# EAGLE board Resistor_Resistor (EAGLE 8.3.0), part 15 of 32
## Placement (x,y rotation side) (continued)
R17993  10K  [0201]  133.86,118.31 0 top
R17994  10K  [0201]  133.86,118.92 0 top
R17995  10K  [0201]  133.86,119.53 0 top
R17996  10K  [0201]  133.86,120.14 0 top
R17997  10K  [0201]  133.86,120.75 0 top
R17998  10K  [0201]  133.86,121.36 0 top
R17999  10K  [0201]  133.86,121.97 0 top
R18000  10K  [0201]  133.86,122.58 0 top
R18001  10K  [0201]  135.08,1.27 0 top
R18002  10K  [0201]  135.08,1.88 0 top
R18003  10K  [0201]  135.08,2.49 0 top
R18004  10K  [0201]  135.08,3.1 0 top
R18005  10K  [0201]  135.08,3.71 0 top
R18006  10K  [0201]  135.08,4.32 0 top
R18007  10K  [0201]  135.08,4.93 0 top
R18008  10K  [0201]  135.08,5.54 0 top
R18009  10K  [0201]  135.08,6.15 0 top
R18010  10K  [0201]  135.08,6.76 0 top
R18011  10K  [0201]  135.08,7.37 0 top
R18012  10K  [0201]  135.08,7.98 0 top
R18013  10K  [0201]  135.08,8.59 0 top
R18014  10K  [0201]  135.08,9.19 0 top
R18015  10K  [0201]  135.08,9.8 0 top
R18016  10K  [0201]  135.08,10.41 0 top
R18017  10K  [0201]  135.08,11.02 0 top
R18018  10K  [0201]  135.08,11.63 0 top
R18019  10K  [0201]  135.08,12.24 0 top
R18020  10K  [0201]  135.08,12.85 0 top
R18021  10K  [0201]  135.08,13.46 0 top
R18022  10K  [0201]  135.08,14.07 0 top
R18023  10K  [0201]  135.08,14.68 0 top
R18024  10K  [0201]  135.08,15.29 0 top
R18025  10K  [0201]  135.08,15.9 0 top
R18026  10K  [0201]  135.08,16.51 0 top
R18027  10K  [0201]  135.08,17.12 0 top
R18028  10K  [0201]  135.08,17.73 0 top
R18029  10K  [0201]  135.08,18.34 0 top
R18030  10K  [0201]  135.08,18.95 0 top
R18031  10K  [0201]  135.08,19.56 0 top
R18032  10K  [0201]  135.08,20.17 0 top
R18033  10K  [0201]  135.08,20.78 0 top
R18034  10K  [0201]  135.08,21.39 0 top
R18035  10K  [0201]  135.08,22 0 top
R18036  10K  [0201]  135.08,22.61 0 top
R18037  10K  [0201]  135.08,23.22 0 top
R18038  10K  [0201]  135.08,23.83 0 top
R18039  10K  [0201]  135.08,24.43 0 top
R18040  10K  [0201]  135.08,25.04 0 top
R18041  10K  [0201]  135.08,25.65 0 top
R18042  10K  [0201]  135.08,26.26 0 top
R18043  10K  [0201]  135.08,26.87 0 top
R18044  10K  [0201]  135.08,27.48 0 top
R18045  10K  [0201]  135.08,28.09 0 top
R18046  10K  [0201]  135.08,28.7 0 top
R18047  10K  [0201]  135.08,29.31 0 top
R18048  10K  [0201]  135.08,29.92 0 top
R18049  10K  [0201]  135.08,30.53 0 top
R18050  10K  [0201]  135.08,31.14 0 top
R18051  10K  [0201]  135.08,31.75 0 top
R18052  10K  [0201]  135.08,32.36 0 top
R18053  10K  [0201]  135.08,32.97 0 top
R18054  10K  [0201]  135.08,33.58 0 top
R18055  10K  [0201]  135.08,34.19 0 top
R18056  10K  [0201]  135.08,34.8 0 top
R18057  10K  [0201]  135.08,35.41 0 top
R18058  10K  [0201]  135.08,36.02 0 top
R18059  10K  [0201]  135.08,36.63 0 top
R18060  10K  [0201]  135.08,37.24 0 top
R18061  10K  [0201]  135.08,37.85 0 top
R18062  10K  [0201]  135.08,38.46 0 top
R18063  10K  [0201]  135.08,39.07 0 top
R18064  10K  [0201]  135.08,39.67 0 top
R18065  10K  [0201]  135.08,40.28 0 top
R18066  10K  [0201]  135.08,40.89 0 top
R18067  10K  [0201]  135.08,41.5 0 top
R18068  10K  [0201]  135.08,42.11 0 top
R18069  10K  [0201]  135.08,42.72 0 top
R18070  10K  [0201]  135.08,43.33 0 top
R18071  10K  [0201]  135.08,43.94 0 top
R18072  10K  [0201]  135.08,44.55 0 top
R18073  10K  [0201]  135.08,45.16 0 top
R18074  10K  [0201]  135.08,45.77 0 top
R18075  10K  [0201]  135.08,46.38 0 top
R18076  10K  [0201]  135.08,46.99 0 top
R18077  10K  [0201]  135.08,47.6 0 top
R18078  10K  [0201]  135.08,48.21 0 top
R18079  10K  [0201]  135.08,48.82 0 top
R18080  10K  [0201]  135.08,49.43 0 top
R18081  10K  [0201]  135.08,50.04 0 top
R18082  10K  [0201]  135.08,50.65 0 top
R18083  10K  [0201]  135.08,51.26 0 top
R18084  10K  [0201]  135.08,51.87 0 top
R18085  10K  [0201]  135.08,52.48 0 top
R18086  10K  [0201]  135.08,53.09 0 top
R18087  10K  [0201]  135.08,53.7 0 top
R18088  10K  [0201]  135.08,54.31 0 top
R18089  10K  [0201]  135.08,54.91 0 top
R18090  10K  [0201]  135.08,55.52 0 top
R18091  10K  [0201]  135.08,56.13 0 top
R18092  10K  [0201]  135.08,56.74 0 top
R18093  10K  [0201]  135.08,57.35 0 top
R18094  10K  [0201]  135.08,57.96 0 top
R18095  10K  [0201]  135.08,58.57 0 top
R18096  10K  [0201]  135.08,59.18 0 top
R18097  10K  [0201]  135.08,59.79 0 top
R18098  10K  [0201]  135.08,60.4 0 top
R18099  10K  [0201]  135.08,61.01 0 top
R18100  10K  [0201]  135.08,61.62 0 top
R18101  10K  [0201]  135.08,62.23 0 top
R18102  10K  [0201]  135.08,62.84 0 top
R18103  10K  [0201]  135.08,63.45 0 top
R18104  10K  [0201]  135.08,64.06 0 top
R18105  10K  [0201]  135.08,64.67 0 top
R18106  10K  [0201]  135.08,65.28 0 top
R18107  10K  [0201]  135.08,65.89 0 top
R18108  10K  [0201]  135.08,66.5 0 top
R18109  10K  [0201]  135.08,67.11 0 top
R18110  10K  [0201]  135.08,67.72 0 top
R18111  10K  [0201]  135.08,68.33 0 top
R18112  10K  [0201]  135.08,68.94 0 top
R18113  10K  [0201]  135.08,69.55 0 top
R18114  10K  [0201]  135.08,70.15 0 top
R18115  10K  [0201]  135.08,70.76 0 top
R18116  10K  [0201]  135.08,71.37 0 top
R18117  10K  [0201]  135.08,71.98 0 top
R18118  10K  [0201]  135.08,72.59 0 top
R18119  10K  [0201]  135.08,73.2 0 top
R18120  10K  [0201]  135.08,73.81 0 top
R18121  10K  [0201]  135.08,74.42 0 top
R18122  10K  [0201]  135.08,75.03 0 top
R18123  10K  [0201]  135.08,75.64 0 top
R18124  10K  [0201]  135.08,76.25 0 top
R18125  10K  [0201]  135.08,76.86 0 top
R18126  10K  [0201]  135.08,77.47 0 top
R18127  10K  [0201]  135.08,78.08 0 top
R18128  10K  [0201]  135.08,78.69 0 top
R18129  10K  [0201]  135.08,79.3 0 top
R18130  10K  [0201]  135.08,79.91 0 top
R18131  10K  [0201]  135.08,80.52 0 top
R18132  10K  [0201]  135.08,81.13 0 top
R18133  10K  [0201]  135.08,81.74 0 top
R18134  10K  [0201]  135.08,82.35 0 top
R18135  10K  [0201]  135.08,82.96 0 top
R18136  10K  [0201]  135.08,83.57 0 top
R18137  10K  [0201]  135.08,84.18 0 top
R18138  10K  [0201]  135.08,84.79 0 top
R18139  10K  [0201]  135.08,85.39 0 top
R18140  10K  [0201]  135.08,86 0 top
R18141  10K  [0201]  135.08,86.61 0 top
R18142  10K  [0201]  135.08,87.22 0 top
R18143  10K  [0201]  135.08,87.83 0 top
R18144  10K  [0201]  135.08,88.44 0 top
R18145  10K  [0201]  135.08,89.05 0 top
R18146  10K  [0201]  135.08,89.66 0 top
R18147  10K  [0201]  135.08,90.27 0 top
R18148  10K  [0201]  135.08,90.88 0 top
R18149  10K  [0201]  135.08,91.49 0 top
R18150  10K  [0201]  135.08,92.1 0 top
R18151  10K  [0201]  135.08,92.71 0 top
R18152  10K  [0201]  135.08,93.32 0 top
R18153  10K  [0201]  135.08,93.93 0 top
R18154  10K  [0201]  135.08,94.54 0 top
R18155  10K  [0201]  135.08,95.15 0 top
R18156  10K  [0201]  135.08,95.76 0 top
R18157  10K  [0201]  135.08,96.37 0 top
R18158  10K  [0201]  135.08,96.98 0 top
R18159  10K  [0201]  135.08,97.59 0 top
R18160  10K  [0201]  135.08,98.2 0 top
R18161  10K  [0201]  135.08,98.81 0 top
R18162  10K  [0201]  135.08,99.42 0 top
R18163  10K  [0201]  135.08,100.03 0 top
R18164  10K  [0201]  135.08,100.63 0 top
R18165  10K  [0201]  135.08,101.24 0 top
R18166  10K  [0201]  135.08,101.85 0 top
R18167  10K  [0201]  135.08,102.46 0 top
R18168  10K  [0201]  135.08,103.07 0 top
R18169  10K  [0201]  135.08,103.68 0 top
R18170  10K  [0201]  135.08,104.29 0 top
R18171  10K  [0201]  135.08,104.9 0 top
R18172  10K  [0201]  135.08,105.51 0 top
R18173  10K  [0201]  135.08,106.12 0 top
R18174  10K  [0201]  135.08,106.73 0 top
R18175  10K  [0201]  135.08,107.34 0 top
R18176  10K  [0201]  135.08,107.95 0 top
R18177  10K  [0201]  135.08,108.56 0 top
R18178  10K  [0201]  135.08,109.17 0 top
R18179  10K  [0201]  135.08,109.78 0 top
R18180  10K  [0201]  135.08,110.39 0 top
R18181  10K  [0201]  135.08,111 0 top
R18182  10K  [0201]  135.08,111.61 0 top
R18183  10K  [0201]  135.08,112.22 0 top
R18184  10K  [0201]  135.08,112.83 0 top
R18185  10K  [0201]  135.08,113.44 0 top
R18186  10K  [0201]  135.08,114.05 0 top
R18187  10K  [0201]  135.08,114.66 0 top
R18188  10K  [0201]  135.08,115.27 0 top
R18189  10K  [0201]  135.08,115.87 0 top
R18190  10K  [0201]  135.08,116.48 0 top
R18191  10K  [0201]  135.08,117.09 0 top
R18192  10K  [0201]  135.08,117.7 0 top
R18193  10K  [0201]  135.08,118.31 0 top
R18194  10K  [0201]  135.08,118.92 0 top
R18195  10K  [0201]  135.08,119.53 0 top
R18196  10K  [0201]  135.08,120.14 0 top
R18197  10K  [0201]  135.08,120.75 0 top
R18198  10K  [0201]  135.08,121.36 0 top
R18199  10K  [0201]  135.08,121.97 0 top
R18200  10K  [0201]  135.08,122.58 0 top
R18201  10K  [0201]  136.3,1.27 0 top
R18202  10K  [0201]  136.3,1.88 0 top
R18203  10K  [0201]  136.3,2.49 0 top
R18204  10K  [0201]  136.3,3.1 0 top
R18205  10K  [0201]  136.3,3.71 0 top
R18206  10K  [0201]  136.3,4.32 0 top
R18207  10K  [0201]  136.3,4.93 0 top
R18208  10K  [0201]  136.3,5.54 0 top
R18209  10K  [0201]  136.3,6.15 0 top
R18210  10K  [0201]  136.3,6.76 0 top
R18211  10K  [0201]  136.3,7.37 0 top
R18212  10K  [0201]  136.3,7.98 0 top
R18213  10K  [0201]  136.3,8.59 0 top
R18214  10K  [0201]  136.3,9.19 0 top
R18215  10K  [0201]  136.3,9.8 0 top
R18216  10K  [0201]  136.3,10.41 0 top
R18217  10K  [0201]  136.3,11.02 0 top
R18218  10K  [0201]  136.3,11.63 0 top
R18219  10K  [0201]  136.3,12.24 0 top
R18220  10K  [0201]  136.3,12.85 0 top
R18221  10K  [0201]  136.3,13.46 0 top
R18222  10K  [0201]  136.3,14.07 0 top
R18223  10K  [0201]  136.3,14.68 0 top
R18224  10K  [0201]  136.3,15.29 0 top
R18225  10K  [0201]  136.3,15.9 0 top
R18226  10K  [0201]  136.3,16.51 0 top
R18227  10K  [0201]  136.3,17.12 0 top
R18228  10K  [0201]  136.3,17.73 0 top
R18229  10K  [0201]  136.3,18.34 0 top
R18230  10K  [0201]  136.3,18.95 0 top
R18231  10K  [0201]  136.3,19.56 0 top
R18232  10K  [0201]  136.3,20.17 0 top
R18233  10K  [0201]  136.3,20.78 0 top
R18234  10K  [0201]  136.3,21.39 0 top
R18235  10K  [0201]  136.3,22 0 top
R18236  10K  [0201]  136.3,22.61 0 top
R18237  10K  [0201]  136.3,23.22 0 top
R18238  10K  [0201]  136.3,23.83 0 top
R18239  10K  [0201]  136.3,24.43 0 top
R18240  10K  [0201]  136.3,25.04 0 top
R18241  10K  [0201]  136.3,25.65 0 top
R18242  10K  [0201]  136.3,26.26 0 top
R18243  10K  [0201]  136.3,26.87 0 top
R18244  10K  [0201]  136.3,27.48 0 top
R18245  10K  [0201]  136.3,28.09 0 top
R18246  10K  [0201]  136.3,28.7 0 top
R18247  10K  [0201]  136.3,29.31 0 top
R18248  10K  [0201]  136.3,29.92 0 top
R18249  10K  [0201]  136.3,30.53 0 top
R18250  10K  [0201]  136.3,31.14 0 top
R18251  10K  [0201]  136.3,31.75 0 top
R18252  10K  [0201]  136.3,32.36 0 top
R18253  10K  [0201]  136.3,32.97 0 top
R18254  10K  [0201]  136.3,33.58 0 top
R18255  10K  [0201]  136.3,34.19 0 top
R18256  10K  [0201]  136.3,34.8 0 top
R18257  10K  [0201]  136.3,35.41 0 top
R18258  10K  [0201]  136.3,36.02 0 top
R18259  10K  [0201]  136.3,36.63 0 top
R18260  10K  [0201]  136.3,37.24 0 top
R18261  10K  [0201]  136.3,37.85 0 top
R18262  10K  [0201]  136.3,38.46 0 top
R18263  10K  [0201]  136.3,39.07 0 top
R18264  10K  [0201]  136.3,39.67 0 top
R18265  10K  [0201]  136.3,40.28 0 top
R18266  10K  [0201]  136.3,40.89 0 top
R18267  10K  [0201]  136.3,41.5 0 top
R18268  10K  [0201]  136.3,42.11 0 top
R18269  10K  [0201]  136.3,42.72 0 top
R18270  10K  [0201]  136.3,43.33 0 top
R18271  10K  [0201]  136.3,43.94 0 top
R18272  10K  [0201]  136.3,44.55 0 top
R18273  10K  [0201]  136.3,45.16 0 top
R18274  10K  [0201]  136.3,45.77 0 top
R18275  10K  [0201]  136.3,46.38 0 top
R18276  10K  [0201]  136.3,46.99 0 top
R18277  10K  [0201]  136.3,47.6 0 top
R18278  10K  [0201]  136.3,48.21 0 top
R18279  10K  [0201]  136.3,48.82 0 top
R18280  10K  [0201]  136.3,49.43 0 top
R18281  10K  [0201]  136.3,50.04 0 top
R18282  10K  [0201]  136.3,50.65 0 top
R18283  10K  [0201]  136.3,51.26 0 top
R18284  10K  [0201]  136.3,51.87 0 top
R18285  10K  [0201]  136.3,52.48 0 top
R18286  10K  [0201]  136.3,53.09 0 top
R18287  10K  [0201]  136.3,53.7 0 top
R18288  10K  [0201]  136.3,54.31 0 top
R18289  10K  [0201]  136.3,54.91 0 top
R18290  10K  [0201]  136.3,55.52 0 top
R18291  10K  [0201]  136.3,56.13 0 top
R18292  10K  [0201]  136.3,56.74 0 top
R18293  10K  [0201]  136.3,57.35 0 top
R18294  10K  [0201]  136.3,57.96 0 top
R18295  10K  [0201]  136.3,58.57 0 top
R18296  10K  [0201]  136.3,59.18 0 top
R18297  10K  [0201]  136.3,59.79 0 top
R18298  10K  [0201]  136.3,60.4 0 top
R18299  10K  [0201]  136.3,61.01 0 top
R18300  10K  [0201]  136.3,61.62 0 top
R18301  10K  [0201]  136.3,62.23 0 top
R18302  10K  [0201]  136.3,62.84 0 top
R18303  10K  [0201]  136.3,63.45 0 top
R18304  10K  [0201]  136.3,64.06 0 top
R18305  10K  [0201]  136.3,64.67 0 top
R18306  10K  [0201]  136.3,65.28 0 top
R18307  10K  [0201]  136.3,65.89 0 top
R18308  10K  [0201]  136.3,66.5 0 top
R18309  10K  [0201]  136.3,67.11 0 top
R18310  10K  [0201]  136.3,67.72 0 top
R18311  10K  [0201]  136.3,68.33 0 top
R18312  10K  [0201]  136.3,68.94 0 top
R18313  10K  [0201]  136.3,69.55 0 top
R18314  10K  [0201]  136.3,70.15 0 top
R18315  10K  [0201]  136.3,70.76 0 top
R18316  10K  [0201]  136.3,71.37 0 top
R18317  10K  [0201]  136.3,71.98 0 top
R18318  10K  [0201]  136.3,72.59 0 top
R18319  10K  [0201]  136.3,73.2 0 top
R18320  10K  [0201]  136.3,73.81 0 top
R18321  10K  [0201]  136.3,74.42 0 top
R18322  10K  [0201]  136.3,75.03 0 top
R18323  10K  [0201]  136.3,75.64 0 top
R18324  10K  [0201]  136.3,76.25 0 top
R18325  10K  [0201]  136.3,76.86 0 top
R18326  10K  [0201]  136.3,77.47 0 top
R18327  10K  [0201]  136.3,78.08 0 top
R18328  10K  [0201]  136.3,78.69 0 top
R18329  10K  [0201]  136.3,79.3 0 top
R18330  10K  [0201]  136.3,79.91 0 top
R18331  10K  [0201]  136.3,80.52 0 top
R18332  10K  [0201]  136.3,81.13 0 top
R18333  10K  [0201]  136.3,81.74 0 top
R18334  10K  [0201]  136.3,82.35 0 top
R18335  10K  [0201]  136.3,82.96 0 top
R18336  10K  [0201]  136.3,83.57 0 top
R18337  10K  [0201]  136.3,84.18 0 top
R18338  10K  [0201]  136.3,84.79 0 top
R18339  10K  [0201]  136.3,85.39 0 top
R18340  10K  [0201]  136.3,86 0 top
R18341  10K  [0201]  136.3,86.61 0 top
R18342  10K  [0201]  136.3,87.22 0 top
R18343  10K  [0201]  136.3,87.83 0 top
R18344  10K  [0201]  136.3,88.44 0 top
R18345  10K  [0201]  136.3,89.05 0 top
R18346  10K  [0201]  136.3,89.66 0 top
R18347  10K  [0201]  136.3,90.27 0 top
R18348  10K  [0201]  136.3,90.88 0 top
R18349  10K  [0201]  136.3,91.49 0 top
R18350  10K  [0201]  136.3,92.1 0 top
R18351  10K  [0201]  136.3,92.71 0 top
R18352  10K  [0201]  136.3,93.32 0 top
R18353  10K  [0201]  136.3,93.93 0 top
R18354  10K  [0201]  136.3,94.54 0 top
R18355  10K  [0201]  136.3,95.15 0 top
R18356  10K  [0201]  136.3,95.76 0 top
R18357  10K  [0201]  136.3,96.37 0 top
R18358  10K  [0201]  136.3,96.98 0 top
R18359  10K  [0201]  136.3,97.59 0 top
R18360  10K  [0201]  136.3,98.2 0 top
R18361  10K  [0201]  136.3,98.81 0 top
R18362  10K  [0201]  136.3,99.42 0 top
R18363  10K  [0201]  136.3,100.03 0 top
R18364  10K  [0201]  136.3,100.63 0 top
R18365  10K  [0201]  136.3,101.24 0 top
R18366  10K  [0201]  136.3,101.85 0 top
R18367  10K  [0201]  136.3,102.46 0 top
R18368  10K  [0201]  136.3,103.07 0 top
R18369  10K  [0201]  136.3,103.68 0 top
R18370  10K  [0201]  136.3,104.29 0 top
R18371  10K  [0201]  136.3,104.9 0 top
R18372  10K  [0201]  136.3,105.51 0 top
R18373  10K  [0201]  136.3,106.12 0 top
R18374  10K  [0201]  136.3,106.73 0 top
R18375  10K  [0201]  136.3,107.34 0 top
R18376  10K  [0201]  136.3,107.95 0 top
R18377  10K  [0201]  136.3,108.56 0 top
R18378  10K  [0201]  136.3,109.17 0 top
R18379  10K  [0201]  136.3,109.78 0 top
R18380  10K  [0201]  136.3,110.39 0 top
R18381  10K  [0201]  136.3,111 0 top
R18382  10K  [0201]  136.3,111.61 0 top
R18383  10K  [0201]  136.3,112.22 0 top
R18384  10K  [0201]  136.3,112.83 0 top
R18385  10K  [0201]  136.3,113.44 0 top
R18386  10K  [0201]  136.3,114.05 0 top
R18387  10K  [0201]  136.3,114.66 0 top
R18388  10K  [0201]  136.3,115.27 0 top
R18389  10K  [0201]  136.3,115.87 0 top
R18390  10K  [0201]  136.3,116.48 0 top
R18391  10K  [0201]  136.3,117.09 0 top
R18392  10K  [0201]  136.3,117.7 0 top
R18393  10K  [0201]  136.3,118.31 0 top
R18394  10K  [0201]  136.3,118.92 0 top
R18395  10K  [0201]  136.3,119.53 0 top
R18396  10K  [0201]  136.3,120.14 0 top
R18397  10K  [0201]  136.3,120.75 0 top
R18398  10K  [0201]  136.3,121.36 0 top
R18399  10K  [0201]  136.3,121.97 0 top
R18400  10K  [0201]  136.3,122.58 0 top
R18401  10K  [0201]  137.52,1.27 0 top
R18402  10K  [0201]  137.52,1.88 0 top
R18403  10K  [0201]  137.52,2.49 0 top
R18404  10K  [0201]  137.52,3.1 0 top
R18405  10K  [0201]  137.52,3.71 0 top
R18406  10K  [0201]  137.52,4.32 0 top
R18407  10K  [0201]  137.52,4.93 0 top
R18408  10K  [0201]  137.52,5.54 0 top
R18409  10K  [0201]  137.52,6.15 0 top
R18410  10K  [0201]  137.52,6.76 0 top
R18411  10K  [0201]  137.52,7.37 0 top
R18412  10K  [0201]  137.52,7.98 0 top
R18413  10K  [0201]  137.52,8.59 0 top
R18414  10K  [0201]  137.52,9.19 0 top
R18415  10K  [0201]  137.52,9.8 0 top
R18416  10K  [0201]  137.52,10.41 0 top
R18417  10K  [0201]  137.52,11.02 0 top
R18418  10K  [0201]  137.52,11.63 0 top
R18419  10K  [0201]  137.52,12.24 0 top
R18420  10K  [0201]  137.52,12.85 0 top
R18421  10K  [0201]  137.52,13.46 0 top
R18422  10K  [0201]  137.52,14.07 0 top
R18423  10K  [0201]  137.52,14.68 0 top
R18424  10K  [0201]  137.52,15.29 0 top
R18425  10K  [0201]  137.52,15.9 0 top
R18426  10K  [0201]  137.52,16.51 0 top
R18427  10K  [0201]  137.52,17.12 0 top
R18428  10K  [0201]  137.52,17.73 0 top
R18429  10K  [0201]  137.52,18.34 0 top
R18430  10K  [0201]  137.52,18.95 0 top
R18431  10K  [0201]  137.52,19.56 0 top
R18432  10K  [0201]  137.52,20.17 0 top
R18433  10K  [0201]  137.52,20.78 0 top
R18434  10K  [0201]  137.52,21.39 0 top
R18435  10K  [0201]  137.52,22 0 top
R18436  10K  [0201]  137.52,22.61 0 top
R18437  10K  [0201]  137.52,23.22 0 top
R18438  10K  [0201]  137.52,23.83 0 top
R18439  10K  [0201]  137.52,24.43 0 top
R18440  10K  [0201]  137.52,25.04 0 top
R18441  10K  [0201]  137.52,25.65 0 top
R18442  10K  [0201]  137.52,26.26 0 top
R18443  10K  [0201]  137.52,26.87 0 top
R18444  10K  [0201]  137.52,27.48 0 top
R18445  10K  [0201]  137.52,28.09 0 top
R18446  10K  [0201]  137.52,28.7 0 top
R18447  10K  [0201]  137.52,29.31 0 top
R18448  10K  [0201]  137.52,29.92 0 top
R18449  10K  [0201]  137.52,30.53 0 top
R18450  10K  [0201]  137.52,31.14 0 top
R18451  10K  [0201]  137.52,31.75 0 top
R18452  10K  [0201]  137.52,32.36 0 top
R18453  10K  [0201]  137.52,32.97 0 top
R18454  10K  [0201]  137.52,33.58 0 top
R18455  10K  [0201]  137.52,34.19 0 top
R18456  10K  [0201]  137.52,34.8 0 top
R18457  10K  [0201]  137.52,35.41 0 top
R18458  10K  [0201]  137.52,36.02 0 top
R18459  10K  [0201]  137.52,36.63 0 top
R18460  10K  [0201]  137.52,37.24 0 top
R18461  10K  [0201]  137.52,37.85 0 top
R18462  10K  [0201]  137.52,38.46 0 top
R18463  10K  [0201]  137.52,39.07 0 top
R18464  10K  [0201]  137.52,39.67 0 top
R18465  10K  [0201]  137.52,40.28 0 top
R18466  10K  [0201]  137.52,40.89 0 top
R18467  10K  [0201]  137.52,41.5 0 top
R18468  10K  [0201]  137.52,42.11 0 top
R18469  10K  [0201]  137.52,42.72 0 top
R18470  10K  [0201]  137.52,43.33 0 top
R18471  10K  [0201]  137.52,43.94 0 top
R18472  10K  [0201]  137.52,44.55 0 top
R18473  10K  [0201]  137.52,45.16 0 top
R18474  10K  [0201]  137.52,45.77 0 top
R18475  10K  [0201]  137.52,46.38 0 top
R18476  10K  [0201]  137.52,46.99 0 top
R18477  10K  [0201]  137.52,47.6 0 top
R18478  10K  [0201]  137.52,48.21 0 top
R18479  10K  [0201]  137.52,48.82 0 top
R18480  10K  [0201]  137.52,49.43 0 top
R18481  10K  [0201]  137.52,50.04 0 top
R18482  10K  [0201]  137.52,50.65 0 top
R18483  10K  [0201]  137.52,51.26 0 top
R18484  10K  [0201]  137.52,51.87 0 top
R18485  10K  [0201]  137.52,52.48 0 top
R18486  10K  [0201]  137.52,53.09 0 top
R18487  10K  [0201]  137.52,53.7 0 top
R18488  10K  [0201]  137.52,54.31 0 top
R18489  10K  [0201]  137.52,54.91 0 top
R18490  10K  [0201]  137.52,55.52 0 top
R18491  10K  [0201]  137.52,56.13 0 top
R18492  10K  [0201]  137.52,56.74 0 top
R18493  10K  [0201]  137.52,57.35 0 top
R18494  10K  [0201]  137.52,57.96 0 top
R18495  10K  [0201]  137.52,58.57 0 top
R18496  10K  [0201]  137.52,59.18 0 top
R18497  10K  [0201]  137.52,59.79 0 top
R18498  10K  [0201]  137.52,60.4 0 top
R18499  10K  [0201]  137.52,61.01 0 top
R18500  10K  [0201]  137.52,61.62 0 top
R18501  10K  [0201]  137.52,62.23 0 top
R18502  10K  [0201]  137.52,62.84 0 top
R18503  10K  [0201]  137.52,63.45 0 top
R18504  10K  [0201]  137.52,64.06 0 top
R18505  10K  [0201]  137.52,64.67 0 top
R18506  10K  [0201]  137.52,65.28 0 top
R18507  10K  [0201]  137.52,65.89 0 top
R18508  10K  [0201]  137.52,66.5 0 top
R18509  10K  [0201]  137.52,67.11 0 top
R18510  10K  [0201]  137.52,67.72 0 top
R18511  10K  [0201]  137.52,68.33 0 top
R18512  10K  [0201]  137.52,68.94 0 top
R18513  10K  [0201]  137.52,69.55 0 top
R18514  10K  [0201]  137.52,70.15 0 top
R18515  10K  [0201]  137.52,70.76 0 top
R18516  10K  [0201]  137.52,71.37 0 top
R18517  10K  [0201]  137.52,71.98 0 top
R18518  10K  [0201]  137.52,72.59 0 top
R18519  10K  [0201]  137.52,73.2 0 top
R18520  10K  [0201]  137.52,73.81 0 top
R18521  10K  [0201]  137.52,74.42 0 top
R18522  10K  [0201]  137.52,75.03 0 top
R18523  10K  [0201]  137.52,75.64 0 top
R18524  10K  [0201]  137.52,76.25 0 top
R18525  10K  [0201]  137.52,76.86 0 top
R18526  10K  [0201]  137.52,77.47 0 top
R18527  10K  [0201]  137.52,78.08 0 top
R18528  10K  [0201]  137.52,78.69 0 top
R18529  10K  [0201]  137.52,79.3 0 top
R18530  10K  [0201]  137.52,79.91 0 top
R18531  10K  [0201]  137.52,80.52 0 top
R18532  10K  [0201]  137.52,81.13 0 top
R18533  10K  [0201]  137.52,81.74 0 top
R18534  10K  [0201]  137.52,82.35 0 top
R18535  10K  [0201]  137.52,82.96 0 top
R18536  10K  [0201]  137.52,83.57 0 top
R18537  10K  [0201]  137.52,84.18 0 top
R18538  10K  [0201]  137.52,84.79 0 top
R18539  10K  [0201]  137.52,85.39 0 top
R18540  10K  [0201]  137.52,86 0 top
R18541  10K  [0201]  137.52,86.61 0 top
R18542  10K  [0201]  137.52,87.22 0 top
R18543  10K  [0201]  137.52,87.83 0 top
R18544  10K  [0201]  137.52,88.44 0 top
R18545  10K  [0201]  137.52,89.05 0 top
R18546  10K  [0201]  137.52,89.66 0 top
R18547  10K  [0201]  137.52,90.27 0 top
R18548  10K  [0201]  137.52,90.88 0 top
R18549  10K  [0201]  137.52,91.49 0 top
R18550  10K  [0201]  137.52,92.1 0 top
R18551  10K  [0201]  137.52,92.71 0 top
R18552  10K  [0201]  137.52,93.32 0 top
R18553  10K  [0201]  137.52,93.93 0 top
R18554  10K  [0201]  137.52,94.54 0 top
R18555  10K  [0201]  137.52,95.15 0 top
R18556  10K  [0201]  137.52,95.76 0 top
R18557  10K  [0201]  137.52,96.37 0 top
R18558  10K  [0201]  137.52,96.98 0 top
R18559  10K  [0201]  137.52,97.59 0 top
R18560  10K  [0201]  137.52,98.2 0 top
R18561  10K  [0201]  137.52,98.81 0 top
R18562  10K  [0201]  137.52,99.42 0 top
R18563  10K  [0201]  137.52,100.03 0 top
R18564  10K  [0201]  137.52,100.63 0 top
R18565  10K  [0201]  137.52,101.24 0 top
R18566  10K  [0201]  137.52,101.85 0 top
R18567  10K  [0201]  137.52,102.46 0 top
R18568  10K  [0201]  137.52,103.07 0 top
R18569  10K  [0201]  137.52,103.68 0 top
R18570  10K  [0201]  137.52,104.29 0 top
R18571  10K  [0201]  137.52,104.9 0 top
R18572  10K  [0201]  137.52,105.51 0 top
R18573  10K  [0201]  137.52,106.12 0 top
R18574  10K  [0201]  137.52,106.73 0 top
R18575  10K  [0201]  137.52,107.34 0 top
R18576  10K  [0201]  137.52,107.95 0 top
R18577  10K  [0201]  137.52,108.56 0 top
R18578  10K  [0201]  137.52,109.17 0 top
R18579  10K  [0201]  137.52,109.78 0 top
R18580  10K  [0201]  137.52,110.39 0 top
R18581  10K  [0201]  137.52,111 0 top
R18582  10K  [0201]  137.52,111.61 0 top
R18583  10K  [0201]  137.52,112.22 0 top
R18584  10K  [0201]  137.52,112.83 0 top
R18585  10K  [0201]  137.52,113.44 0 top
R18586  10K  [0201]  137.52,114.05 0 top
R18587  10K  [0201]  137.52,114.66 0 top
R18588  10K  [0201]  137.52,115.27 0 top
R18589  10K  [0201]  137.52,115.87 0 top
R18590  10K  [0201]  137.52,116.48 0 top
R18591  10K  [0201]  137.52,117.09 0 top
R18592  10K  [0201]  137.52,117.7 0 top
R18593  10K  [0201]  137.52,118.31 0 top
R18594  10K  [0201]  137.52,118.92 0 top
R18595  10K  [0201]  137.52,119.53 0 top
R18596  10K  [0201]  137.52,120.14 0 top
R18597  10K  [0201]  137.52,120.75 0 top
R18598  10K  [0201]  137.52,121.36 0 top
R18599  10K  [0201]  137.52,121.97 0 top
R18600  10K  [0201]  137.52,122.58 0 top
R18601  10K  [0201]  138.73,1.27 0 top
R18602  10K  [0201]  138.73,1.88 0 top
R18603  10K  [0201]  138.73,2.49 0 top
R18604  10K  [0201]  138.73,3.1 0 top
R18605  10K  [0201]  138.73,3.71 0 top
R18606  10K  [0201]  138.73,4.32 0 top
R18607  10K  [0201]  138.73,4.93 0 top
R18608  10K  [0201]  138.73,5.54 0 top
R18609  10K  [0201]  138.73,6.15 0 top
R18610  10K  [0201]  138.73,6.76 0 top
R18611  10K  [0201]  138.73,7.37 0 top
R18612  10K  [0201]  138.73,7.98 0 top
R18613  10K  [0201]  138.73,8.59 0 top
R18614  10K  [0201]  138.73,9.19 0 top
R18615  10K  [0201]  138.73,9.8 0 top
R18616  10K  [0201]  138.73,10.41 0 top
R18617  10K  [0201]  138.73,11.02 0 top
R18618  10K  [0201]  138.73,11.63 0 top
R18619  10K  [0201]  138.73,12.24 0 top
R18620  10K  [0201]  138.73,12.85 0 top
R18621  10K  [0201]  138.73,13.46 0 top
R18622  10K  [0201]  138.73,14.07 0 top
R18623  10K  [0201]  138.73,14.68 0 top
R18624  10K  [0201]  138.73,15.29 0 top
R18625  10K  [0201]  138.73,15.9 0 top
R18626  10K  [0201]  138.73,16.51 0 top
R18627  10K  [0201]  138.73,17.12 0 top
R18628  10K  [0201]  138.73,17.73 0 top
R18629  10K  [0201]  138.73,18.34 0 top
R18630  10K  [0201]  138.73,18.95 0 top
R18631  10K  [0201]  138.73,19.56 0 top
R18632  10K  [0201]  138.73,20.17 0 top
R18633  10K  [0201]  138.73,20.78 0 top
R18634  10K  [0201]  138.73,21.39 0 top
R18635  10K  [0201]  138.73,22 0 top
R18636  10K  [0201]  138.73,22.61 0 top
R18637  10K  [0201]  138.73,23.22 0 top
R18638  10K  [0201]  138.73,23.83 0 top
R18639  10K  [0201]  138.73,24.43 0 top
R18640  10K  [0201]  138.73,25.04 0 top
R18641  10K  [0201]  138.73,25.65 0 top
R18642  10K  [0201]  138.73,26.26 0 top
R18643  10K  [0201]  138.73,26.87 0 top
R18644  10K  [0201]  138.73,27.48 0 top
R18645  10K  [0201]  138.73,28.09 0 top
R18646  10K  [0201]  138.73,28.7 0 top
R18647  10K  [0201]  138.73,29.31 0 top
R18648  10K  [0201]  138.73,29.92 0 top
R18649  10K  [0201]  138.73,30.53 0 top
R18650  10K  [0201]  138.73,31.14 0 top
R18651  10K  [0201]  138.73,31.75 0 top
R18652  10K  [0201]  138.73,32.36 0 top
R18653  10K  [0201]  138.73,32.97 0 top
R18654  10K  [0201]  138.73,33.58 0 top
R18655  10K  [0201]  138.73,34.19 0 top
R18656  10K  [0201]  138.73,34.8 0 top
R18657  10K  [0201]  138.73,35.41 0 top
R18658  10K  [0201]  138.73,36.02 0 top
R18659  10K  [0201]  138.73,36.63 0 top
R18660  10K  [0201]  138.73,37.24 0 top
R18661  10K  [0201]  138.73,37.85 0 top
R18662  10K  [0201]  138.73,38.46 0 top
R18663  10K  [0201]  138.73,39.07 0 top
R18664  10K  [0201]  138.73,39.67 0 top
R18665  10K  [0201]  138.73,40.28 0 top
R18666  10K  [0201]  138.73,40.89 0 top
R18667  10K  [0201]  138.73,41.5 0 top
R18668  10K  [0201]  138.73,42.11 0 top
R18669  10K  [0201]  138.73,42.72 0 top
R18670  10K  [0201]  138.73,43.33 0 top
R18671  10K  [0201]  138.73,43.94 0 top
R18672  10K  [0201]  138.73,44.55 0 top
R18673  10K  [0201]  138.73,45.16 0 top
R18674  10K  [0201]  138.73,45.77 0 top
R18675  10K  [0201]  138.73,46.38 0 top
R18676  10K  [0201]  138.73,46.99 0 top
R18677  10K  [0201]  138.73,47.6 0 top
R18678  10K  [0201]  138.73,48.21 0 top
R18679  10K  [0201]  138.73,48.82 0 top
R18680  10K  [0201]  138.73,49.43 0 top
R18681  10K  [0201]  138.73,50.04 0 top
R18682  10K  [0201]  138.73,50.65 0 top
R18683  10K  [0201]  138.73,51.26 0 top
R18684  10K  [0201]  138.73,51.87 0 top
R18685  10K  [0201]  138.73,52.48 0 top
R18686  10K  [0201]  138.73,53.09 0 top
R18687  10K  [0201]  138.73,53.7 0 top
R18688  10K  [0201]  138.73,54.31 0 top
R18689  10K  [0201]  138.73,54.91 0 top
R18690  10K  [0201]  138.73,55.52 0 top
R18691  10K  [0201]  138.73,56.13 0 top
R18692  10K  [0201]  138.73,56.74 0 top
R18693  10K  [0201]  138.73,57.35 0 top
R18694  10K  [0201]  138.73,57.96 0 top
R18695  10K  [0201]  138.73,58.57 0 top
R18696  10K  [0201]  138.73,59.18 0 top
R18697  10K  [0201]  138.73,59.79 0 top
R18698  10K  [0201]  138.73,60.4 0 top
R18699  10K  [0201]  138.73,61.01 0 top
R18700  10K  [0201]  138.73,61.62 0 top
R18701  10K  [0201]  138.73,62.23 0 top
R18702  10K  [0201]  138.73,62.84 0 top
R18703  10K  [0201]  138.73,63.45 0 top
R18704  10K  [0201]  138.73,64.06 0 top
R18705  10K  [0201]  138.73,64.67 0 top
R18706  10K  [0201]  138.73,65.28 0 top
R18707  10K  [0201]  138.73,65.89 0 top
R18708  10K  [0201]  138.73,66.5 0 top
R18709  10K  [0201]  138.73,67.11 0 top
R18710  10K  [0201]  138.73,67.72 0 top
R18711  10K  [0201]  138.73,68.33 0 top
R18712  10K  [0201]  138.73,68.94 0 top
R18713  10K  [0201]  138.73,69.55 0 top
R18714  10K  [0201]  138.73,70.15 0 top
R18715  10K  [0201]  138.73,70.76 0 top
R18716  10K  [0201]  138.73,71.37 0 top
R18717  10K  [0201]  138.73,71.98 0 top
R18718  10K  [0201]  138.73,72.59 0 top
R18719  10K  [0201]  138.73,73.2 0 top
R18720  10K  [0201]  138.73,73.81 0 top
R18721  10K  [0201]  138.73,74.42 0 top
R18722  10K  [0201]  138.73,75.03 0 top
R18723  10K  [0201]  138.73,75.64 0 top
R18724  10K  [0201]  138.73,76.25 0 top
R18725  10K  [0201]  138.73,76.86 0 top
R18726  10K  [0201]  138.73,77.47 0 top
R18727  10K  [0201]  138.73,78.08 0 top
R18728  10K  [0201]  138.73,78.69 0 top
R18729  10K  [0201]  138.73,79.3 0 top
R18730  10K  [0201]  138.73,79.91 0 top
R18731  10K  [0201]  138.73,80.52 0 top
R18732  10K  [0201]  138.73,81.13 0 top
R18733  10K  [0201]  138.73,81.74 0 top
R18734  10K  [0201]  138.73,82.35 0 top
R18735  10K  [0201]  138.73,82.96 0 top
R18736  10K  [0201]  138.73,83.57 0 top
R18737  10K  [0201]  138.73,84.18 0 top
R18738  10K  [0201]  138.73,84.79 0 top
R18739  10K  [0201]  138.73,85.39 0 top
R18740  10K  [0201]  138.73,86 0 top
R18741  10K  [0201]  138.73,86.61 0 top
R18742  10K  [0201]  138.73,87.22 0 top
R18743  10K  [0201]  138.73,87.83 0 top
R18744  10K  [0201]  138.73,88.44 0 top
R18745  10K  [0201]  138.73,89.05 0 top
R18746  10K  [0201]  138.73,89.66 0 top
R18747  10K  [0201]  138.73,90.27 0 top
R18748  10K  [0201]  138.73,90.88 0 top
R18749  10K  [0201]  138.73,91.49 0 top
R18750  10K  [0201]  138.73,92.1 0 top
R18751  10K  [0201]  138.73,92.71 0 top
R18752  10K  [0201]  138.73,93.32 0 top
R18753  10K  [0201]  138.73,93.93 0 top
R18754  10K  [0201]  138.73,94.54 0 top
R18755  10K  [0201]  138.73,95.15 0 top
R18756  10K  [0201]  138.73,95.76 0 top
R18757  10K  [0201]  138.73,96.37 0 top
R18758  10K  [0201]  138.73,96.98 0 top
R18759  10K  [0201]  138.73,97.59 0 top
R18760  10K  [0201]  138.73,98.2 0 top
R18761  10K  [0201]  138.73,98.81 0 top
R18762  10K  [0201]  138.73,99.42 0 top
R18763  10K  [0201]  138.73,100.03 0 top
R18764  10K  [0201]  138.73,100.63 0 top
R18765  10K  [0201]  138.73,101.24 0 top
R18766  10K  [0201]  138.73,101.85 0 top
R18767  10K  [0201]  138.73,102.46 0 top
R18768  10K  [0201]  138.73,103.07 0 top
R18769  10K  [0201]  138.73,103.68 0 top
R18770  10K  [0201]  138.73,104.29 0 top
R18771  10K  [0201]  138.73,104.9 0 top
R18772  10K  [0201]  138.73,105.51 0 top
R18773  10K  [0201]  138.73,106.12 0 top
R18774  10K  [0201]  138.73,106.73 0 top
R18775  10K  [0201]  138.73,107.34 0 top
R18776  10K  [0201]  138.73,107.95 0 top
R18777  10K  [0201]  138.73,108.56 0 top
R18778  10K  [0201]  138.73,109.17 0 top
R18779  10K  [0201]  138.73,109.78 0 top
R18780  10K  [0201]  138.73,110.39 0 top
R18781  10K  [0201]  138.73,111 0 top
R18782  10K  [0201]  138.73,111.61 0 top
R18783  10K  [0201]  138.73,112.22 0 top
R18784  10K  [0201]  138.73,112.83 0 top
R18785  10K  [0201]  138.73,113.44 0 top
R18786  10K  [0201]  138.73,114.05 0 top
R18787  10K  [0201]  138.73,114.66 0 top
R18788  10K  [0201]  138.73,115.27 0 top
R18789  10K  [0201]  138.73,115.87 0 top
R18790  10K  [0201]  138.73,116.48 0 top
R18791  10K  [0201]  138.73,117.09 0 top
R18792  10K  [0201]  138.73,117.7 0 top
R18793  10K  [0201]  138.73,118.31 0 top
R18794  10K  [0201]  138.73,118.92 0 top
R18795  10K  [0201]  138.73,119.53 0 top
R18796  10K  [0201]  138.73,120.14 0 top
R18797  10K  [0201]  138.73,120.75 0 top
R18798  10K  [0201]  138.73,121.36 0 top
R18799  10K  [0201]  138.73,121.97 0 top
R18800  10K  [0201]  138.73,122.58 0 top
R18801  10K  [0201]  139.95,1.27 0 top
R18802  10K  [0201]  139.95,1.88 0 top
R18803  10K  [0201]  139.95,2.49 0 top
R18804  10K  [0201]  139.95,3.1 0 top
R18805  10K  [0201]  139.95,3.71 0 top
R18806  10K  [0201]  139.95,4.32 0 top
R18807  10K  [0201]  139.95,4.93 0 top
R18808  10K  [0201]  139.95,5.54 0 top
R18809  10K  [0201]  139.95,6.15 0 top
R18810  10K  [0201]  139.95,6.76 0 top
R18811  10K  [0201]  139.95,7.37 0 top
R18812  10K  [0201]  139.95,7.98 0 top
R18813  10K  [0201]  139.95,8.59 0 top
R18814  10K  [0201]  139.95,9.19 0 top
R18815  10K  [0201]  139.95,9.8 0 top
R18816  10K  [0201]  139.95,10.41 0 top
R18817  10K  [0201]  139.95,11.02 0 top
R18818  10K  [0201]  139.95,11.63 0 top
R18819  10K  [0201]  139.95,12.24 0 top
R18820  10K  [0201]  139.95,12.85 0 top
R18821  10K  [0201]  139.95,13.46 0 top
R18822  10K  [0201]  139.95,14.07 0 top
R18823  10K  [0201]  139.95,14.68 0 top
R18824  10K  [0201]  139.95,15.29 0 top
R18825  10K  [0201]  139.95,15.9 0 top
R18826  10K  [0201]  139.95,16.51 0 top
R18827  10K  [0201]  139.95,17.12 0 top
R18828  10K  [0201]  139.95,17.73 0 top
R18829  10K  [0201]  139.95,18.34 0 top
R18830  10K  [0201]  139.95,18.95 0 top
R18831  10K  [0201]  139.95,19.56 0 top
R18832  10K  [0201]  139.95,20.17 0 top
R18833  10K  [0201]  139.95,20.78 0 top
R18834  10K  [0201]  139.95,21.39 0 top
R18835  10K  [0201]  139.95,22 0 top
R18836  10K  [0201]  139.95,22.61 0 top
R18837  10K  [0201]  139.95,23.22 0 top
R18838  10K  [0201]  139.95,23.83 0 top
R18839  10K  [0201]  139.95,24.43 0 top
R18840  10K  [0201]  139.95,25.04 0 top
R18841  10K  [0201]  139.95,25.65 0 top
R18842  10K  [0201]  139.95,26.26 0 top
R18843  10K  [0201]  139.95,26.87 0 top
R18844  10K  [0201]  139.95,27.48 0 top
R18845  10K  [0201]  139.95,28.09 0 top
R18846  10K  [0201]  139.95,28.7 0 top
R18847  10K  [0201]  139.95,29.31 0 top
R18848  10K  [0201]  139.95,29.92 0 top
R18849  10K  [0201]  139.95,30.53 0 top
R18850  10K  [0201]  139.95,31.14 0 top
R18851  10K  [0201]  139.95,31.75 0 top
R18852  10K  [0201]  139.95,32.36 0 top
R18853  10K  [0201]  139.95,32.97 0 top
R18854  10K  [0201]  139.95,33.58 0 top
R18855  10K  [0201]  139.95,34.19 0 top
R18856  10K  [0201]  139.95,34.8 0 top
R18857  10K  [0201]  139.95,35.41 0 top
R18858  10K  [0201]  139.95,36.02 0 top
R18859  10K  [0201]  139.95,36.63 0 top
R18860  10K  [0201]  139.95,37.24 0 top
R18861  10K  [0201]  139.95,37.85 0 top
R18862  10K  [0201]  139.95,38.46 0 top
R18863  10K  [0201]  139.95,39.07 0 top
R18864  10K  [0201]  139.95,39.67 0 top
R18865  10K  [0201]  139.95,40.28 0 top
R18866  10K  [0201]  139.95,40.89 0 top
R18867  10K  [0201]  139.95,41.5 0 top
R18868  10K  [0201]  139.95,42.11 0 top
R18869  10K  [0201]  139.95,42.72 0 top
R18870  10K  [0201]  139.95,43.33 0 top
R18871  10K  [0201]  139.95,43.94 0 top
R18872  10K  [0201]  139.95,44.55 0 top
R18873  10K  [0201]  139.95,45.16 0 top
R18874  10K  [0201]  139.95,45.77 0 top
R18875  10K  [0201]  139.95,46.38 0 top
R18876  10K  [0201]  139.95,46.99 0 top
R18877  10K  [0201]  139.95,47.6 0 top
R18878  10K  [0201]  139.95,48.21 0 top
R18879  10K  [0201]  139.95,48.82 0 top
R18880  10K  [0201]  139.95,49.43 0 top
R18881  10K  [0201]  139.95,50.04 0 top
R18882  10K  [0201]  139.95,50.65 0 top
R18883  10K  [0201]  139.95,51.26 0 top
R18884  10K  [0201]  139.95,51.87 0 top
R18885  10K  [0201]  139.95,52.48 0 top
R18886  10K  [0201]  139.95,53.09 0 top
R18887  10K  [0201]  139.95,53.7 0 top
R18888  10K  [0201]  139.95,54.31 0 top
R18889  10K  [0201]  139.95,54.91 0 top
R18890  10K  [0201]  139.95,55.52 0 top
R18891  10K  [0201]  139.95,56.13 0 top
R18892  10K  [0201]  139.95,56.74 0 top
R18893  10K  [0201]  139.95,57.35 0 top
R18894  10K  [0201]  139.95,57.96 0 top
R18895  10K  [0201]  139.95,58.57 0 top
R18896  10K  [0201]  139.95,59.18 0 top
R18897  10K  [0201]  139.95,59.79 0 top
R18898  10K  [0201]  139.95,60.4 0 top
R18899  10K  [0201]  139.95,61.01 0 top
R18900  10K  [0201]  139.95,61.62 0 top
R18901  10K  [0201]  139.95,62.23 0 top
R18902  10K  [0201]  139.95,62.84 0 top
R18903  10K  [0201]  139.95,63.45 0 top
R18904  10K  [0201]  139.95,64.06 0 top
R18905  10K  [0201]  139.95,64.67 0 top
R18906  10K  [0201]  139.95,65.28 0 top
R18907  10K  [0201]  139.95,65.89 0 top
R18908  10K  [0201]  139.95,66.5 0 top
R18909  10K  [0201]  139.95,67.11 0 top
R18910  10K  [0201]  139.95,67.72 0 top
R18911  10K  [0201]  139.95,68.33 0 top
R18912  10K  [0201]  139.95,68.94 0 top
R18913  10K  [0201]  139.95,69.55 0 top
R18914  10K  [0201]  139.95,70.15 0 top
R18915  10K  [0201]  139.95,70.76 0 top
R18916  10K  [0201]  139.95,71.37 0 top
R18917  10K  [0201]  139.95,71.98 0 top
R18918  10K  [0201]  139.95,72.59 0 top
R18919  10K  [0201]  139.95,73.2 0 top
R18920  10K  [0201]  139.95,73.81 0 top
R18921  10K  [0201]  139.95,74.42 0 top
R18922  10K  [0201]  139.95,75.03 0 top
R18923  10K  [0201]  139.95,75.64 0 top
R18924  10K  [0201]  139.95,76.25 0 top
R18925  10K  [0201]  139.95,76.86 0 top
R18926  10K  [0201]  139.95,77.47 0 top
R18927  10K  [0201]  139.95,78.08 0 top
R18928  10K  [0201]  139.95,78.69 0 top
R18929  10K  [0201]  139.95,79.3 0 top
R18930  10K  [0201]  139.95,79.91 0 top
R18931  10K  [0201]  139.95,80.52 0 top
R18932  10K  [0201]  139.95,81.13 0 top
R18933  10K  [0201]  139.95,81.74 0 top
R18934  10K  [0201]  139.95,82.35 0 top
R18935  10K  [0201]  139.95,82.96 0 top
R18936  10K  [0201]  139.95,83.57 0 top
R18937  10K  [0201]  139.95,84.18 0 top
R18938  10K  [0201]  139.95,84.79 0 top
R18939  10K  [0201]  139.95,85.39 0 top
R18940  10K  [0201]  139.95,86 0 top
R18941  10K  [0201]  139.95,86.61 0 top
R18942  10K  [0201]  139.95,87.22 0 top
R18943  10K  [0201]  139.95,87.83 0 top
R18944  10K  [0201]  139.95,88.44 0 top
R18945  10K  [0201]  139.95,89.05 0 top
R18946  10K  [0201]  139.95,89.66 0 top
R18947  10K  [0201]  139.95,90.27 0 top
R18948  10K  [0201]  139.95,90.88 0 top
R18949  10K  [0201]  139.95,91.49 0 top
R18950  10K  [0201]  139.95,92.1 0 top
R18951  10K  [0201]  139.95,92.71 0 top
R18952  10K  [0201]  139.95,93.32 0 top
R18953  10K  [0201]  139.95,93.93 0 top
R18954  10K  [0201]  139.95,94.54 0 top
R18955  10K  [0201]  139.95,95.15 0 top
R18956  10K  [0201]  139.95,95.76 0 top
R18957  10K  [0201]  139.95,96.37 0 top
R18958  10K  [0201]  139.95,96.98 0 top
R18959  10K  [0201]  139.95,97.59 0 top
R18960  10K  [0201]  139.95,98.2 0 top
R18961  10K  [0201]  139.95,98.81 0 top
R18962  10K  [0201]  139.95,99.42 0 top
R18963  10K  [0201]  139.95,100.03 0 top
R18964  10K  [0201]  139.95,100.63 0 top
R18965  10K  [0201]  139.95,101.24 0 top
R18966  10K  [0201]  139.95,101.85 0 top
R18967  10K  [0201]  139.95,102.46 0 top
R18968  10K  [0201]  139.95,103.07 0 top
R18969  10K  [0201]  139.95,103.68 0 top
R18970  10K  [0201]  139.95,104.29 0 top
R18971  10K  [0201]  139.95,104.9 0 top
R18972  10K  [0201]  139.95,105.51 0 top
R18973  10K  [0201]  139.95,106.12 0 top
R18974  10K  [0201]  139.95,106.73 0 top
R18975  10K  [0201]  139.95,107.34 0 top
R18976  10K  [0201]  139.95,107.95 0 top
R18977  10K  [0201]  139.95,108.56 0 top
R18978  10K  [0201]  139.95,109.17 0 top
R18979  10K  [0201]  139.95,109.78 0 top
R18980  10K  [0201]  139.95,110.39 0 top
R18981  10K  [0201]  139.95,111 0 top
R18982  10K  [0201]  139.95,111.61 0 top
R18983  10K  [0201]  139.95,112.22 0 top
R18984  10K  [0201]  139.95,112.83 0 top
R18985  10K  [0201]  139.95,113.44 0 top
R18986  10K  [0201]  139.95,114.05 0 top
R18987  10K  [0201]  139.95,114.66 0 top
R18988  10K  [0201]  139.95,115.27 0 top
R18989  10K  [0201]  139.95,115.87 0 top
R18990  10K  [0201]  139.95,116.48 0 top
R18991  10K  [0201]  139.95,117.09 0 top
R18992  10K  [0201]  139.95,117.7 0 top
R18993  10K  [0201]  139.95,118.31 0 top
R18994  10K  [0201]  139.95,118.92 0 top
R18995  10K  [0201]  139.95,119.53 0 top
R18996  10K  [0201]  139.95,120.14 0 top
R18997  10K  [0201]  139.95,120.75 0 top
R18998  10K  [0201]  139.95,121.36 0 top
R18999  10K  [0201]  139.95,121.97 0 top
R19000  10K  [0201]  139.95,122.58 0 top
R19001  10K  [0201]  141.17,1.27 0 top
R19002  10K  [0201]  141.17,1.88 0 top
R19003  10K  [0201]  141.17,2.49 0 top
R19004  10K  [0201]  141.17,3.1 0 top
R19005  10K  [0201]  141.17,3.71 0 top
R19006  10K  [0201]  141.17,4.32 0 top
R19007  10K  [0201]  141.17,4.93 0 top
R19008  10K  [0201]  141.17,5.54 0 top
R19009  10K  [0201]  141.17,6.15 0 top
R19010  10K  [0201]  141.17,6.76 0 top
R19011  10K  [0201]  141.17,7.37 0 top
R19012  10K  [0201]  141.17,7.98 0 top
R19013  10K  [0201]  141.17,8.59 0 top
R19014  10K  [0201]  141.17,9.19 0 top
R19015  10K  [0201]  141.17,9.8 0 top
R19016  10K  [0201]  141.17,10.41 0 top
R19017  10K  [0201]  141.17,11.02 0 top
R19018  10K  [0201]  141.17,11.63 0 top
R19019  10K  [0201]  141.17,12.24 0 top
R19020  10K  [0201]  141.17,12.85 0 top
R19021  10K  [0201]  141.17,13.46 0 top
R19022  10K  [0201]  141.17,14.07 0 top
R19023  10K  [0201]  141.17,14.68 0 top
R19024  10K  [0201]  141.17,15.29 0 top
R19025  10K  [0201]  141.17,15.9 0 top
R19026  10K  [0201]  141.17,16.51 0 top
R19027  10K  [0201]  141.17,17.12 0 top
R19028  10K  [0201]  141.17,17.73 0 top
R19029  10K  [0201]  141.17,18.34 0 top
R19030  10K  [0201]  141.17,18.95 0 top
R19031  10K  [0201]  141.17,19.56 0 top
R19032  10K  [0201]  141.17,20.17 0 top
R19033  10K  [0201]  141.17,20.78 0 top
R19034  10K  [0201]  141.17,21.39 0 top
R19035  10K  [0201]  141.17,22 0 top
R19036  10K  [0201]  141.17,22.61 0 top
R19037  10K  [0201]  141.17,23.22 0 top
R19038  10K  [0201]  141.17,23.83 0 top
R19039  10K  [0201]  141.17,24.43 0 top
R19040  10K  [0201]  141.17,25.04 0 top
R19041  10K  [0201]  141.17,25.65 0 top
R19042  10K  [0201]  141.17,26.26 0 top
R19043  10K  [0201]  141.17,26.87 0 top
R19044  10K  [0201]  141.17,27.48 0 top
R19045  10K  [0201]  141.17,28.09 0 top
R19046  10K  [0201]  141.17,28.7 0 top
R19047  10K  [0201]  141.17,29.31 0 top
R19048  10K  [0201]  141.17,29.92 0 top
R19049  10K  [0201]  141.17,30.53 0 top
R19050  10K  [0201]  141.17,31.14 0 top
R19051  10K  [0201]  141.17,31.75 0 top
R19052  10K  [0201]  141.17,32.36 0 top
R19053  10K  [0201]  141.17,32.97 0 top
R19054  10K  [0201]  141.17,33.58 0 top
R19055  10K  [0201]  141.17,34.19 0 top
R19056  10K  [0201]  141.17,34.8 0 top
R19057  10K  [0201]  141.17,35.41 0 top
R19058  10K  [0201]  141.17,36.02 0 top
R19059  10K  [0201]  141.17,36.63 0 top
R19060  10K  [0201]  141.17,37.24 0 top
R19061  10K  [0201]  141.17,37.85 0 top
R19062  10K  [0201]  141.17,38.46 0 top
R19063  10K  [0201]  141.17,39.07 0 top
R19064  10K  [0201]  141.17,39.67 0 top
R19065  10K  [0201]  141.17,40.28 0 top
R19066  10K  [0201]  141.17,40.89 0 top
R19067  10K  [0201]  141.17,41.5 0 top
R19068  10K  [0201]  141.17,42.11 0 top
R19069  10K  [0201]  141.17,42.72 0 top
R19070  10K  [0201]  141.17,43.33 0 top
R19071  10K  [0201]  141.17,43.94 0 top
R19072  10K  [0201]  141.17,44.55 0 top
R19073  10K  [0201]  141.17,45.16 0 top
R19074  10K  [0201]  141.17,45.77 0 top
R19075  10K  [0201]  141.17,46.38 0 top
R19076  10K  [0201]  141.17,46.99 0 top
R19077  10K  [0201]  141.17,47.6 0 top
R19078  10K  [0201]  141.17,48.21 0 top
R19079  10K  [0201]  141.17,48.82 0 top
R19080  10K  [0201]  141.17,49.43 0 top
R19081  10K  [0201]  141.17,50.04 0 top
R19082  10K  [0201]  141.17,50.65 0 top
R19083  10K  [0201]  141.17,51.26 0 top
R19084  10K  [0201]  141.17,51.87 0 top
R19085  10K  [0201]  141.17,52.48 0 top
R19086  10K  [0201]  141.17,53.09 0 top
R19087  10K  [0201]  141.17,53.7 0 top
R19088  10K  [0201]  141.17,54.31 0 top
R19089  10K  [0201]  141.17,54.91 0 top
R19090  10K  [0201]  141.17,55.52 0 top
R19091  10K  [0201]  141.17,56.13 0 top
R19092  10K  [0201]  141.17,56.74 0 top
R19093  10K  [0201]  141.17,57.35 0 top
R19094  10K  [0201]  141.17,57.96 0 top
R19095  10K  [0201]  141.17,58.57 0 top
R19096  10K  [0201]  141.17,59.18 0 top
R19097  10K  [0201]  141.17,59.79 0 top
R19098  10K  [0201]  141.17,60.4 0 top
R19099  10K  [0201]  141.17,61.01 0 top
R19100  10K  [0201]  141.17,61.62 0 top
R19101  10K  [0201]  141.17,62.23 0 top
R19102  10K  [0201]  141.17,62.84 0 top
R19103  10K  [0201]  141.17,63.45 0 top
R19104  10K  [0201]  141.17,64.06 0 top
R19105  10K  [0201]  141.17,64.67 0 top
R19106  10K  [0201]  141.17,65.28 0 top
R19107  10K  [0201]  141.17,65.89 0 top
R19108  10K  [0201]  141.17,66.5 0 top
R19109  10K  [0201]  141.17,67.11 0 top
R19110  10K  [0201]  141.17,67.72 0 top
R19111  10K  [0201]  141.17,68.33 0 top
R19112  10K  [0201]  141.17,68.94 0 top
R19113  10K  [0201]  141.17,69.55 0 top
R19114  10K  [0201]  141.17,70.15 0 top
R19115  10K  [0201]  141.17,70.76 0 top
R19116  10K  [0201]  141.17,71.37 0 top
R19117  10K  [0201]  141.17,71.98 0 top
R19118  10K  [0201]  141.17,72.59 0 top
R19119  10K  [0201]  141.17,73.2 0 top
R19120  10K  [0201]  141.17,73.81 0 top
R19121  10K  [0201]  141.17,74.42 0 top
R19122  10K  [0201]  141.17,75.03 0 top
R19123  10K  [0201]  141.17,75.64 0 top
R19124  10K  [0201]  141.17,76.25 0 top
R19125  10K  [0201]  141.17,76.86 0 top
R19126  10K  [0201]  141.17,77.47 0 top
R19127  10K  [0201]  141.17,78.08 0 top
R19128  10K  [0201]  141.17,78.69 0 top
R19129  10K  [0201]  141.17,79.3 0 top
R19130  10K  [0201]  141.17,79.91 0 top
R19131  10K  [0201]  141.17,80.52 0 top
R19132  10K  [0201]  141.17,81.13 0 top
R19133  10K  [0201]  141.17,81.74 0 top
R19134  10K  [0201]  141.17,82.35 0 top
R19135  10K  [0201]  141.17,82.96 0 top
R19136  10K  [0201]  141.17,83.57 0 top
R19137  10K  [0201]  141.17,84.18 0 top
R19138  10K  [0201]  141.17,84.79 0 top
R19139  10K  [0201]  141.17,85.39 0 top
R19140  10K  [0201]  141.17,86 0 top
R19141  10K  [0201]  141.17,86.61 0 top
R19142  10K  [0201]  141.17,87.22 0 top
R19143  10K  [0201]  141.17,87.83 0 top
R19144  10K  [0201]  141.17,88.44 0 top
R19145  10K  [0201]  141.17,89.05 0 top
R19146  10K  [0201]  141.17,89.66 0 top
R19147  10K  [0201]  141.17,90.27 0 top
R19148  10K  [0201]  141.17,90.88 0 top
R19149  10K  [0201]  141.17,91.49 0 top
R19150  10K  [0201]  141.17,92.1 0 top
R19151  10K  [0201]  141.17,92.71 0 top
R19152  10K  [0201]  141.17,93.32 0 top
R19153  10K  [0201]  141.17,93.93 0 top
R19154  10K  [0201]  141.17,94.54 0 top
R19155  10K  [0201]  141.17,95.15 0 top
R19156  10K  [0201]  141.17,95.76 0 top
R19157  10K  [0201]  141.17,96.37 0 top
R19158  10K  [0201]  141.17,96.98 0 top
R19159  10K  [0201]  141.17,97.59 0 top
R19160  10K  [0201]  141.17,98.2 0 top
R19161  10K  [0201]  141.17,98.81 0 top
R19162  10K  [0201]  141.17,99.42 0 top
R19163  10K  [0201]  141.17,100.03 0 top
R19164  10K  [0201]  141.17,100.63 0 top
R19165  10K  [0201]  141.17,101.24 0 top
R19166  10K  [0201]  141.17,101.85 0 top
R19167  10K  [0201]  141.17,102.46 0 top
R19168  10K  [0201]  141.17,103.07 0 top
R19169  10K  [0201]  141.17,103.68 0 top
R19170  10K  [0201]  141.17,104.29 0 top
R19171  10K  [0201]  141.17,104.9 0 top
R19172  10K  [0201]  141.17,105.51 0 top
R19173  10K  [0201]  141.17,106.12 0 top
R19174  10K  [0201]  141.17,106.73 0 top
R19175  10K  [0201]  141.17,107.34 0 top
R19176  10K  [0201]  141.17,107.95 0 top
R19177  10K  [0201]  141.17,108.56 0 top
R19178  10K  [0201]  141.17,109.17 0 top
R19179  10K  [0201]  141.17,109.78 0 top
R19180  10K  [0201]  141.17,110.39 0 top
R19181  10K  [0201]  141.17,111 0 top
R19182  10K  [0201]  141.17,111.61 0 top
R19183  10K  [0201]  141.17,112.22 0 top
R19184  10K  [0201]  141.17,112.83 0 top
R19185  10K  [0201]  141.17,113.44 0 top
R19186  10K  [0201]  141.17,114.05 0 top
R19187  10K  [0201]  141.17,114.66 0 top
R19188  10K  [0201]  141.17,115.27 0 top
R19189  10K  [0201]  141.17,115.87 0 top
R19190  10K  [0201]  141.17,116.48 0 top
R19191  10K  [0201]  141.17,117.09 0 top
R19192  10K  [0201]  141.17,117.7 0 top
R19193  10K  [0201]  141.17,118.31 0 top
R19194  10K  [0201]  141.17,118.92 0 top
R19195  10K  [0201]  141.17,119.53 0 top
R19196  10K  [0201]  141.17,120.14 0 top
R19197  10K  [0201]  141.17,120.75 0 top
R19198  10K  [0201]  141.17,121.36 0 top
R19199  10K  [0201]  141.17,121.97 0 top
R19200  10K  [0201]  141.17,122.58 0 top
R19201  10K  [0201]  142.39,1.27 0 top
R19202  10K  [0201]  142.39,1.88 0 top
R19203  10K  [0201]  142.39,2.49 0 top
R19204  10K  [0201]  142.39,3.1 0 top
R19205  10K  [0201]  142.39,3.71 0 top
R19206  10K  [0201]  142.39,4.32 0 top
R19207  10K  [0201]  142.39,4.93 0 top
R19208  10K  [0201]  142.39,5.54 0 top
R19209  10K  [0201]  142.39,6.15 0 top
R19210  10K  [0201]  142.39,6.76 0 top
R19211  10K  [0201]  142.39,7.37 0 top
R19212  10K  [0201]  142.39,7.98 0 top
R19213  10K  [0201]  142.39,8.59 0 top
R19214  10K  [0201]  142.39,9.19 0 top
R19215  10K  [0201]  142.39,9.8 0 top
R19216  10K  [0201]  142.39,10.41 0 top
R19217  10K  [0201]  142.39,11.02 0 top
R19218  10K  [0201]  142.39,11.63 0 top
R19219  10K  [0201]  142.39,12.24 0 top
R19220  10K  [0201]  142.39,12.85 0 top
R19221  10K  [0201]  142.39,13.46 0 top
R19222  10K  [0201]  142.39,14.07 0 top
R19223  10K  [0201]  142.39,14.68 0 top
R19224  10K  [0201]  142.39,15.29 0 top
R19225  10K  [0201]  142.39,15.9 0 top
R19226  10K  [0201]  142.39,16.51 0 top
R19227  10K  [0201]  142.39,17.12 0 top
R19228  10K  [0201]  142.39,17.73 0 top
R19229  10K  [0201]  142.39,18.34 0 top
R19230  10K  [0201]  142.39,18.95 0 top
R19231  10K  [0201]  142.39,19.56 0 top
R19232  10K  [0201]  142.39,20.17 0 top
R19233  10K  [0201]  142.39,20.78 0 top
R19234  10K  [0201]  142.39,21.39 0 top
R19235  10K  [0201]  142.39,22 0 top
R19236  10K  [0201]  142.39,22.61 0 top
R19237  10K  [0201]  142.39,23.22 0 top
R19238  10K  [0201]  142.39,23.83 0 top
R19239  10K  [0201]  142.39,24.43 0 top
R19240  10K  [0201]  142.39,25.04 0 top